# EasyEDA Pro project Archive.eprj, board ALU3.0
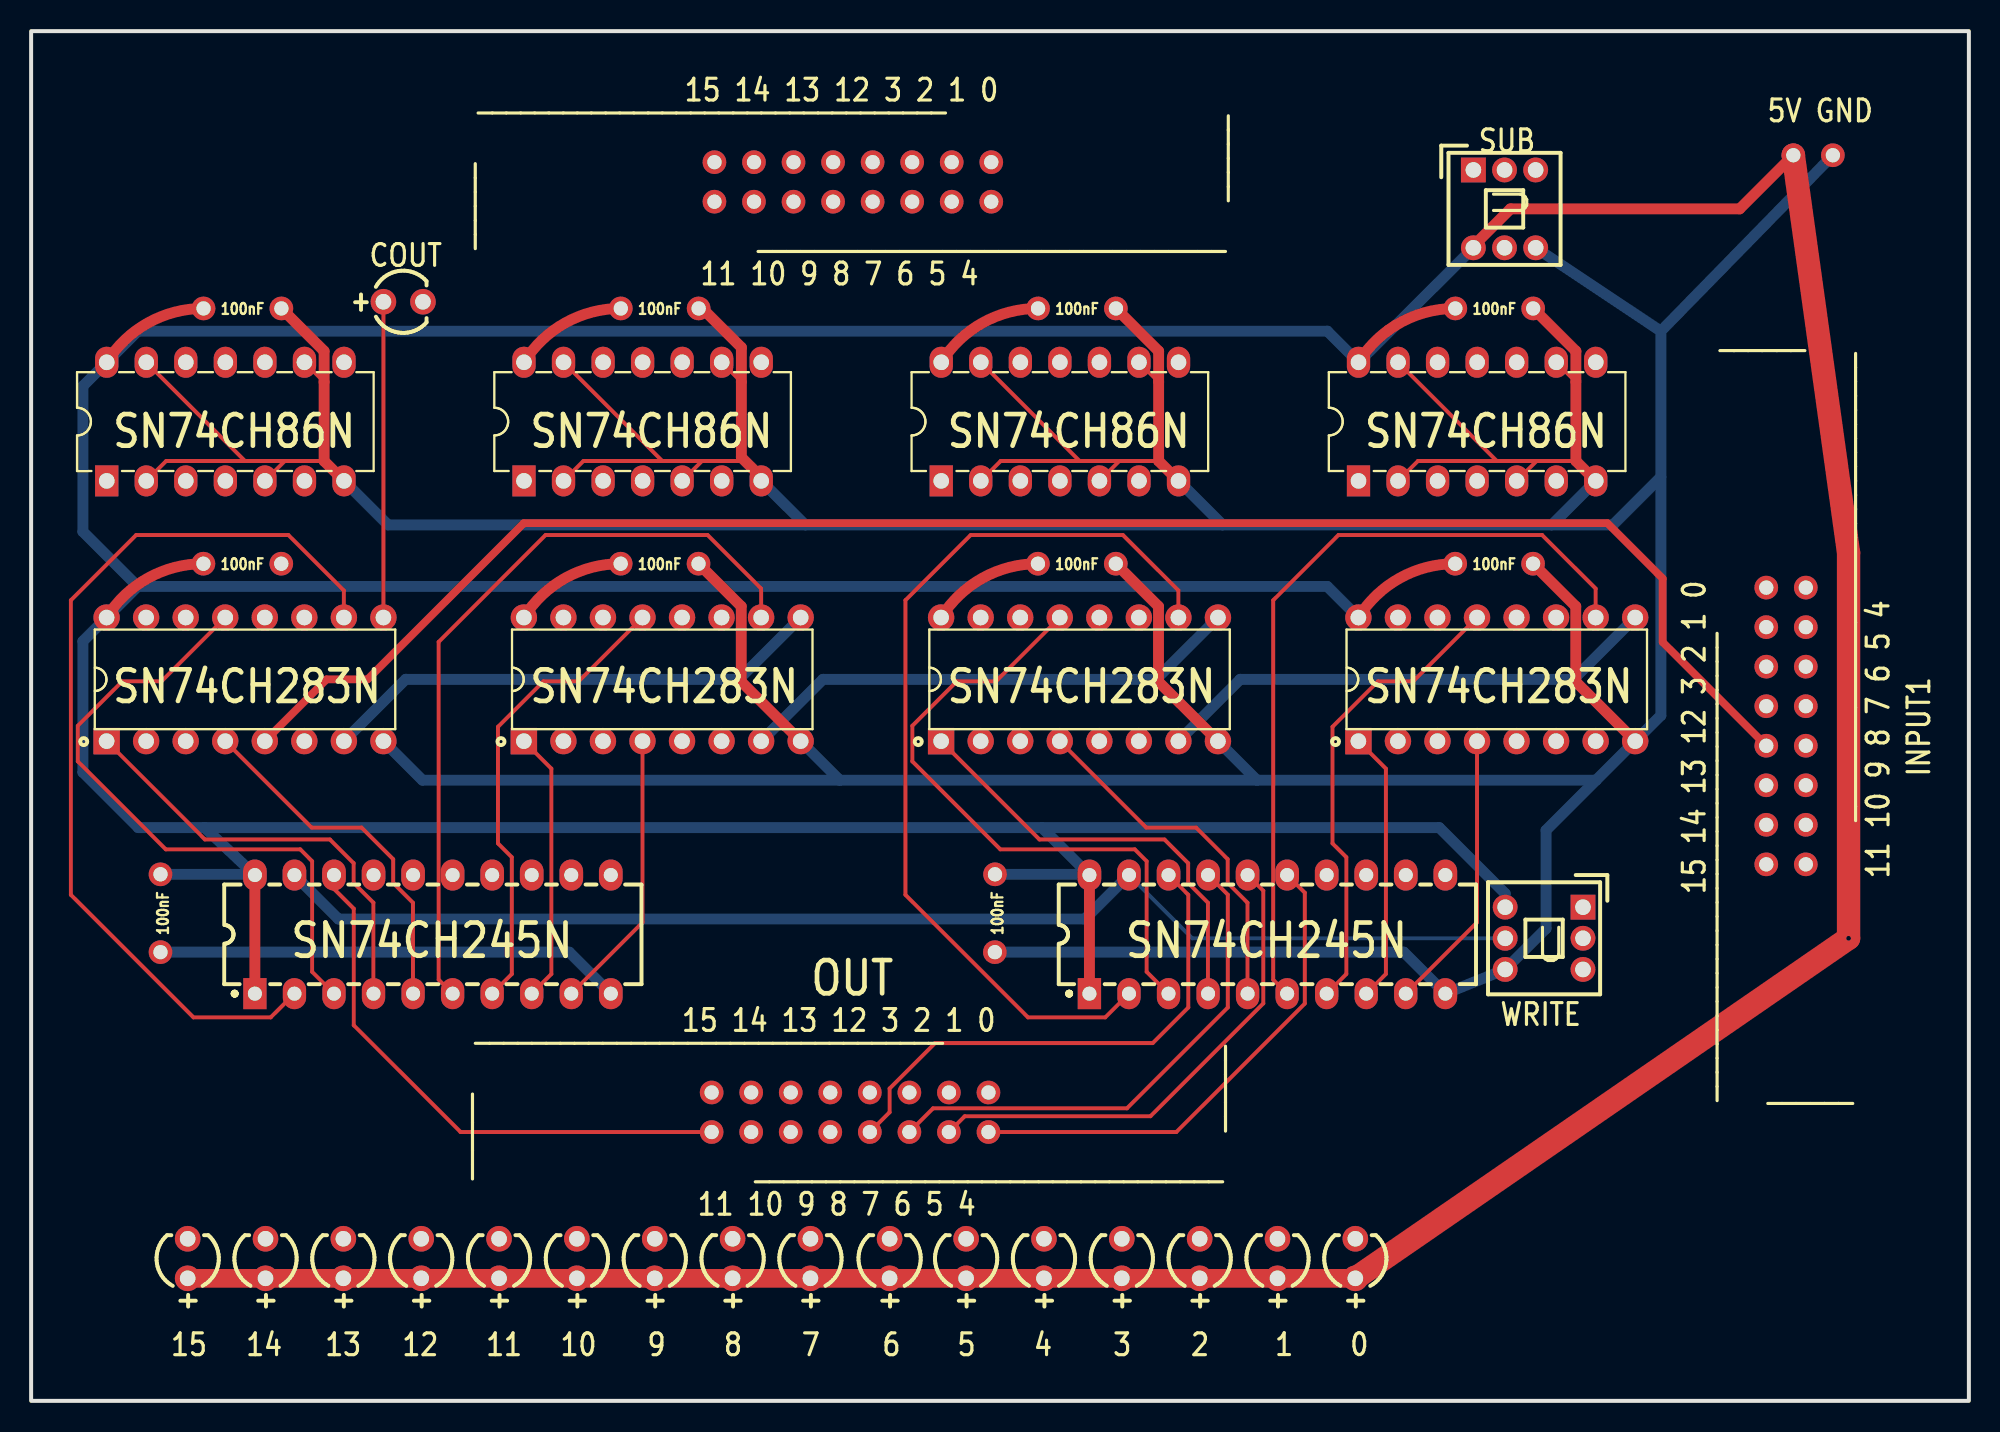
[diagram p12: board, top side]
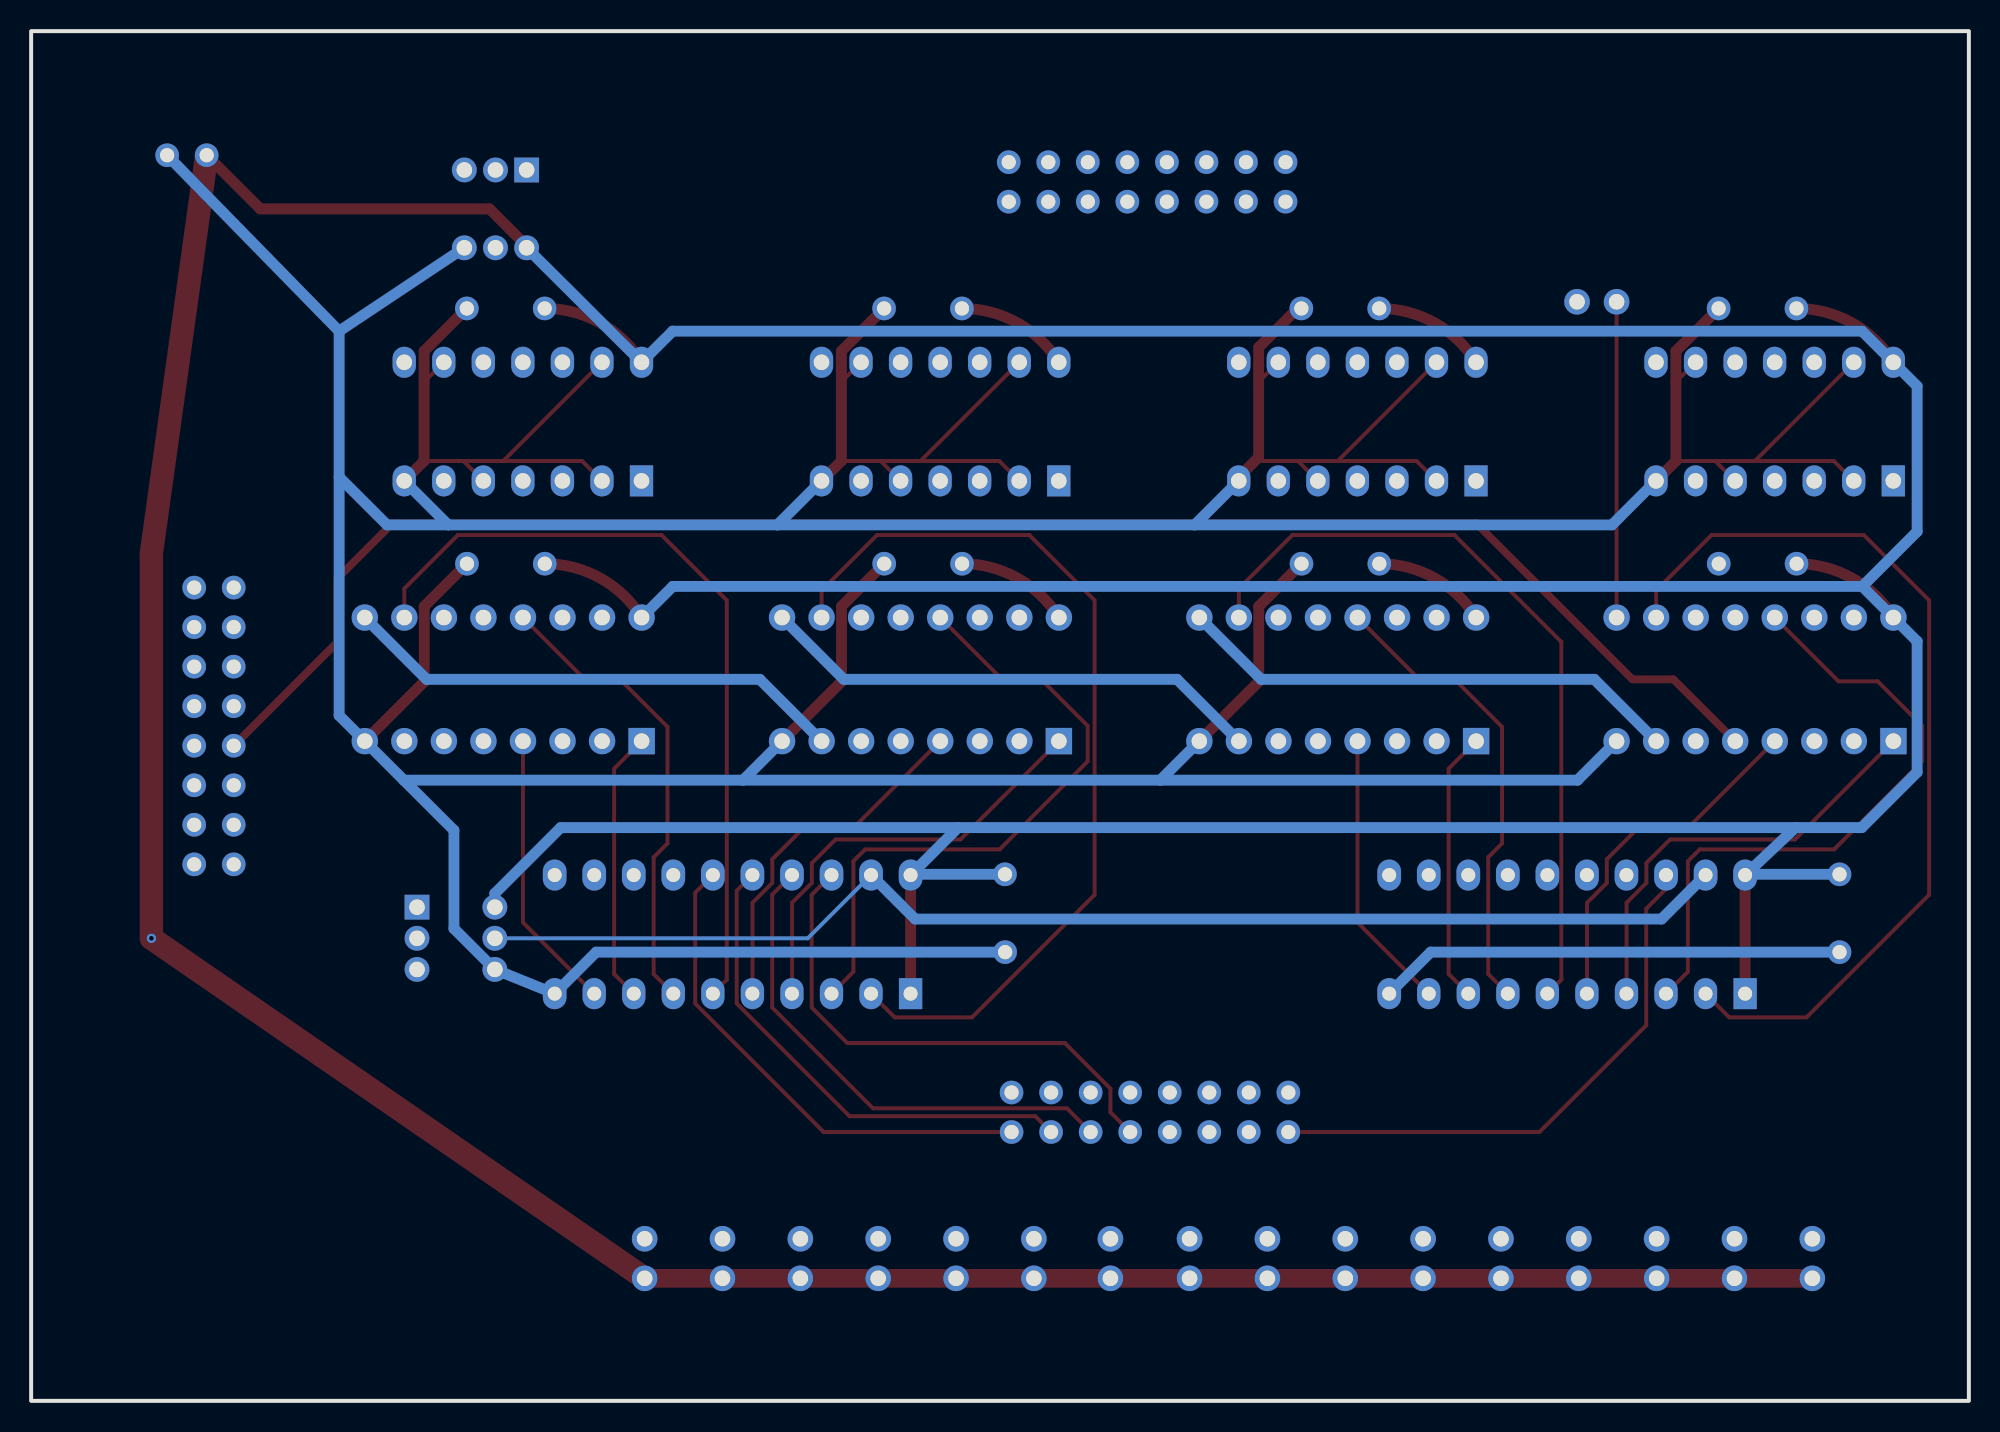
[diagram p13: board, bottom side, seen from below]

Outline 124.46 x 88 mm; copper layers: Top Layer, Inner1, Inner2, Bottom Layer. Coordinates in mm from the lower left corner of the outline.
Outline path: rectangle 0,88 124.46,0
Stack: Top Layer 0.035mm Outer layer thickness 1oz / Dielectric1 0.2104mm 7628 RC49% 8.6mil / Inner1 0.0152mm Inner layer thickness / Dielectric2 1.065mm 1.1mm H/HOZ Copper / Inner2 0.0152mm Inner layer thickness / Dielectric3 0.2104mm 7628 RC49% 8.6mil / Bottom Layer 0.035mm Outer layer thickness 1oz

## Design rules (mm)
template: JLCPCB Capability(Two Layers Board)
spacing copperThickness1oz (default): track to track 0.102, other pairs 0.152 to 0.3
spacing copperThickness2oz: track to track 0.203, other pairs 0.152 to 0.3
track width copperThickness1oz (default): min 0.127, default 0.254, max 2.54
track width copperThickness2oz: min 0.203, default 0.254, max 2.54
differential pair differentialPair (default): width min 0.127, default 0.254, max 2.54; gap min 0.152, default 0.152
via viaSize (default): diameter min 0.5, default 0.61, max 10; hole min 0.3, default 0.305, max 6.3

## Placement (name value [footprint] x y rotation side)
NOREF  -  [Pad_e1800]  43.89 79.58 0 top
NOREF#2  -  [Pad_e1795]  42.87 53.78 90 top
NOREF#3  -  [Pad_e1847]  113.19 80.03 0 top
NOREF#4  -  [Pad_e1811]  51.51 77.04 0 top
NOREF#5  -  [Pad_e1826]  61.49 17.27 0 top
NOREF#6  -  [Pad_e1839]  111.45 47.17 90 top
NOREF#7  -  [Pad_e1837]  96.47 53.78 90 top
NOREF#8  -  [Pad_e1790]  11.07 70.18 90 top
NOREF#9  -  [Pad_e1833]  69.67 53.78 90 top
NOREF#10  -  [Pad_e1852]  113.99 44.63 90 top
NOREF#11  -  [Pad_e1821]  58.95 17.27 0 top
NOREF#12  -  [Pad_e1838]  96.48 70.18 90 top
NOREF#13  -  [Pad_e1853]  113.99 34.47 90 top
NOREF#14  -  [Pad_e1801]  46.25 17.27 0 top
NOREF#15  -  [Pad_e1806]  48.79 19.81 0 top
NOREF#16  -  [Pad_e1842]  111.45 39.55 90 top
NOREF#17  -  [Pad_e1824]  59.13 79.58 0 top
NOREF#18  -  [Pad_e1822]  58.95 19.81 0 top
NOREF#19  -  [Pad_e1808]  48.97 79.58 0 top
NOREF#20  -  [Pad_e1820]  56.59 77.04 0 top
NOREF#21  -  [Pad_e1789]  11.07 53.78 90 top
NOREF#22  -  [Pad_e1791]  16.07 53.78 90 top
NOREF#23  -  [Pad_e1841]  111.45 37.01 90 top
NOREF#24  -  [Pad_e1855]  113.99 39.55 90 top
NOREF#25  -  [Pad_e1799]  43.89 77.04 0 top
NOREF#26  -  [Pad_e1827]  61.67 77.04 0 top
NOREF#27  -  [Pad_e1819]  56.59 79.58 0 top
NOREF#28  -  [Pad_e1804]  46.43 79.58 0 top
NOREF#29  -  [Pad_e1807]  48.97 77.04 0 top
NOREF#30  -  [Pad_e1803]  46.43 77.04 0 top
NOREF#31  -  [Pad_e1792]  16.07 70.18 90 top
NOREF#32  -  [Pad_e1843]  111.45 52.25 90 top
NOREF#33  -  [Pad_e1828]  61.67 79.58 0 top
NOREF#34  -  [Pad_e1848]  113.99 52.25 90 top
NOREF#35  -  [Pad_e1818]  56.41 19.81 0 top
NOREF#36  -  [Pad_e1816]  54.05 79.58 0 top
NOREF#37  -  [Pad_e1812]  51.51 79.58 0 top
NOREF#38  -  [Pad_e1849]  113.99 49.71 90 top
NOREF#39  -  [Pad_e1845]  111.45 42.09 90 top
NOREF#40  -  [Pad_e1854]  113.99 37.01 90 top
NOREF#41  -  [Pad_e1797]  43.71 17.27 0 top
NOREF#42  -  [Pad_e1815]  54.05 77.04 0 top
NOREF#43  -  [Pad_e1834]  69.68 70.18 90 top
NOREF#44  -  [Pad_e1850]  113.99 47.17 90 top
NOREF#45  -  [Pad_e1813]  53.87 19.81 0 top
NOREF#46  -  [Pad_e1831]  64.67 53.78 90 top
NOREF#47  -  [Pad_e1840]  111.45 34.47 90 top
NOREF#48  -  [Pad_e1823]  59.13 77.04 0 top
NOREF#49  -  [Pad_e1805]  48.79 17.27 0 top
NOREF#50  -  [Pad_e1846]  111.45 44.63 90 top
NOREF#51  -  [Pad_e1835]  91.47 53.78 90 top
NOREF#52  -  [Pad_e1810]  51.33 19.81 0 top
NOREF#53  -  [Pad_e1832]  64.68 70.18 90 top
NOREF#54  -  [Pad_e1809]  51.33 17.27 0 top
NOREF#55  -  [Pad_e1825]  61.49 19.81 0 top
NOREF#56  -  [Pad_e1802]  46.25 19.81 0 top
NOREF#57  -  [Pad_e1798]  43.71 19.81 0 top
NOREF#58  -  [Pad_e1829]  61.9 28.83 0 top
NOREF#59  -  [Pad_e1793]  37.87 53.78 90 top
NOREF#60  -  [Pad_e1851]  113.99 42.09 90 top
NOREF#61  -  [Pad_e1856]  115.73 80.03 0 top
NOREF#62  -  [Pad_e1788]  8.31 28.83 180 top
NOREF#63  -  [Pad_e1844]  111.45 49.71 90 top
NOREF#64  -  [Pad_e1836]  91.48 70.18 90 top
NOREF#65  -  [Pad_e1814]  53.87 17.27 0 top
NOREF#66  -  [Pad_e1830]  61.91 33.83 180 top
NOREF#67  -  [Pad_e1794]  37.87 70.18 90 top
NOREF#68  -  [Pad_e1787]  8.31 33.83 180 top
NOREF#69  -  [Pad_e1817]  56.41 17.27 0 top
NOREF#70  -  [Pad_e1796]  42.87 70.18 90 top
SW2  -  [SW-TH_6P-L7.0-W7.0-P2.00]  94.64 76.58 90 top
SW2#2  -  [SW-TH_6P-L7.0-W7.0-P2.00]  97.18 29.72 0 top
U5  SN74HC245N  [DIP-20_L26.8-W6.4-P2.54-LS7.6-BL]  25.8 29.97 0 top
U6  -  [LED-TH_BD4.0-P2.54-FD_RED]  23.9 70.61 0 top
U6#2  -  [DIP-20_L26.8-W6.4-P2.54-LS7.6-BL]  79.4 29.97 0 top
U7  -  [DIP-16_L19.3-W6.4-P2.54-LS7.94-BL]  13.74 46.36 0 top
U7#2  -  [DIP-16_L19.3-W6.4-P2.54-LS7.94-BL]  40.54 46.36 0 top
U7#3  -  [DIP-16_L19.3-W6.4-P2.54-LS7.94-BL]  67.34 46.36 0 top
U7#4  -  [DIP-16_L19.3-W6.4-P2.54-LS7.94-BL]  94.14 46.36 0 top
U8  -  [DIP-14_L19.0-W6.4-P2.54-LS7.6-BL]  12.47 62.92 0 top
U8#2  -  [DIP-14_L19.0-W6.4-P2.54-LS7.6-BL]  39.28 62.92 0 top
U8#3  -  [DIP-14_L19.0-W6.4-P2.54-LS7.6-BL]  66.08 62.92 0 top
U8#4  -  [DIP-14_L19.0-W6.4-P2.54-LS7.6-BL]  92.88 62.92 0 top
U14  -  [LED-TH_BD4.0-P2.54-FD_RED]  10.05 9.14 90 top
U14#2  -  [LED-TH_BD4.0-P2.54-FD_RED]  15.05 9.14 90 top
U14#3  -  [LED-TH_BD4.0-P2.54-FD_RED]  20.05 9.14 90 top
U14#4  -  [LED-TH_BD4.0-P2.54-FD_RED]  25.05 9.14 90 top
U14#5  -  [LED-TH_BD4.0-P2.54-FD_RED]  30.05 9.14 90 top
U14#6  -  [LED-TH_BD4.0-P2.54-FD_RED]  35.05 9.14 90 top
U14#7  -  [LED-TH_BD4.0-P2.54-FD_RED]  40.05 9.14 90 top
U14#8  -  [LED-TH_BD4.0-P2.54-FD_RED]  45.05 9.14 90 top
U14#9  -  [LED-TH_BD4.0-P2.54-FD_RED]  50.05 9.14 90 top
U14#10  -  [LED-TH_BD4.0-P2.54-FD_RED]  55.14 9.14 90 top
U14#11  -  [LED-TH_BD4.0-P2.54-FD_RED]  60.05 9.14 90 top
U14#12  -  [LED-TH_BD4.0-P2.54-FD_RED]  65.05 9.14 90 top
U14#13  -  [LED-TH_BD4.0-P2.54-FD_RED]  70.05 9.14 90 top
U14#14  -  [LED-TH_BD4.0-P2.54-FD_RED]  75.05 9.14 90 top
U14#15  -  [LED-TH_BD4.0-P2.54-FD_RED]  80.05 9.14 90 top
U14#16  -  [LED-TH_BD4.0-P2.54-FD_RED]  85.05 9.14 90 top

## Footprints (pads in the part's own frame, mm; a bottom-side part is the same pattern mirrored in y, then rotated)
DIP-14_L19.0-W6.4-P2.54-LS7.6-BL
  rect 1.5x2 hole 1: 1(-7.62,-3.81)
  oval 1.5x2 hole 1: 2(-5.08,-3.81) 3(-2.54,-3.81) 4(0,-3.81) 5(2.54,-3.81) 6(5.08,-3.81) 7(7.62,-3.81) 8(7.62,3.81) 9(5.08,3.81) 10(2.54,3.81) 11(0,3.81) 12(-2.54,3.81) 13(-5.08,3.81) 14(-7.62,3.81)
DIP-16_L19.3-W6.4-P2.54-LS7.94-BL
  rect 1.7x1.7 hole 1: 1(-8.89,-3.97)
  round 1.7 hole 1: 2(-6.35,-3.97) 3(-3.81,-3.97) 4(-1.27,-3.97) 5(1.27,-3.97) 6(3.81,-3.97) 7(6.35,-3.97) 8(8.89,-3.97) 9(8.89,3.97) 10(6.35,3.97) 11(3.81,3.97) 12(1.27,3.97) 13(-1.27,3.97) 14(-3.81,3.97) 15(-6.35,3.97) 16(-8.89,3.97)
DIP-20_L26.8-W6.4-P2.54-LS7.6-BL
  rect 1.5x2 hole 0.9: 1(-11.43,-3.81)
  oval 1.5x2 hole 0.9: 2(-8.89,-3.81) 3(-6.35,-3.81) 4(-3.81,-3.81) 5(-1.27,-3.81) 6(1.27,-3.81) 7(3.81,-3.81) 8(6.35,-3.81) 9(8.89,-3.81)
  oval 1.524x2 hole 0.9: 10(11.43,-3.81) 11(11.43,3.81) 12(8.89,3.81) 13(6.35,3.81) 14(3.81,3.81) 15(1.27,3.81) 16(-1.27,3.81) 17(-3.81,3.81) 18(-6.35,3.81) 19(-8.89,3.81) 20(-11.43,3.81)
LED-TH_BD4.0-P2.54-FD_RED
  round 1.651 hole 1: 1(-1.27,0) 2(1.27,0)
Pad_e1787
  round 1.524 hole 0.914: 2(0,0)
Pad_e1788
  round 1.524 hole 0.914: 1(0,0)
Pad_e1789
  round 1.524 hole 0.914: 2(0,0)
Pad_e1790
  round 1.524 hole 0.914: 2(0,0)
Pad_e1791
  round 1.524 hole 0.914: 1(0,0)
Pad_e1792
  round 1.524 hole 0.914: 1(0,0)
Pad_e1793
  round 1.524 hole 0.914: 2(0,0)
Pad_e1794
  round 1.524 hole 0.914: 2(0,0)
Pad_e1795
  round 1.524 hole 0.914: 1(0,0)
Pad_e1796
  round 1.524 hole 0.914: 1(0,0)
Pad_e1797
  round 1.524 hole 0.914: 11(0,0)
Pad_e1798
  round 1.524 hole 0.914: 15(0,0)
Pad_e1799
  round 1.524 hole 0.914: 11(0,0)
Pad_e1800
  round 1.524 hole 0.914: 15(0,0)
Pad_e1801
  round 1.524 hole 0.914: 10(0,0)
Pad_e1802
  round 1.524 hole 0.914: 14(0,0)
Pad_e1803
  round 1.524 hole 0.914: 10(0,0)
Pad_e1804
  round 1.524 hole 0.914: 14(0,0)
Pad_e1805
  round 1.524 hole 0.914: 9(0,0)
Pad_e1806
  round 1.524 hole 0.914: 13(0,0)
Pad_e1807
  round 1.524 hole 0.914: 9(0,0)
Pad_e1808
  round 1.524 hole 0.914: 13(0,0)
Pad_e1809
  round 1.524 hole 0.914: 8(0,0)
Pad_e1810
  round 1.524 hole 0.914: 12(0,0)
Pad_e1811
  round 1.524 hole 0.914: 8(0,0)
Pad_e1812
  round 1.524 hole 0.914: 12(0,0)
Pad_e1813
  round 1.524 hole 0.914: 3(0,0)
Pad_e1814
  round 1.524 hole 0.914: 7(0,0)
Pad_e1815
  round 1.524 hole 0.914: 7(0,0)
Pad_e1816
  round 1.524 hole 0.914: 3(0,0)
Pad_e1817
  round 1.524 hole 0.914: 6(0,0)
Pad_e1818
  round 1.524 hole 0.914: 2(0,0)
Pad_e1819
  round 1.524 hole 0.914: 2(0,0)
Pad_e1820
  round 1.524 hole 0.914: 6(0,0)
Pad_e1821
  round 1.524 hole 0.914: 5(0,0)
Pad_e1822
  round 1.524 hole 0.914: 1(0,0)
Pad_e1823
  round 1.524 hole 0.914: 5(0,0)
Pad_e1824
  round 1.524 hole 0.914: 1(0,0)
Pad_e1825
  round 1.524 hole 0.914: 0(0,0)
Pad_e1826
  round 1.524 hole 0.914: 4(0,0)
Pad_e1827
  round 1.524 hole 0.914: 4(0,0)
Pad_e1828
  round 1.524 hole 0.914: 0(0,0)
Pad_e1829
  round 1.524 hole 0.914: 1(0,0)
Pad_e1830
  round 1.524 hole 0.914: 2(0,0)
Pad_e1831
  round 1.524 hole 0.914: 2(0,0)
Pad_e1832
  round 1.524 hole 0.914: 2(0,0)
Pad_e1833
  round 1.524 hole 0.914: 1(0,0)
Pad_e1834
  round 1.524 hole 0.914: 1(0,0)
Pad_e1835
  round 1.524 hole 0.914: 2(0,0)
Pad_e1836
  round 1.524 hole 0.914: 2(0,0)
Pad_e1837
  round 1.524 hole 0.914: 1(0,0)
Pad_e1838
  round 1.524 hole 0.914: 1(0,0)
Pad_e1839
  round 1.524 hole 0.914: 2(0,0)
Pad_e1840
  round 1.524 hole 0.914: 15(0,0)
Pad_e1841
  round 1.524 hole 0.914: 14(0,0)
Pad_e1842
  round 1.524 hole 0.914: 13(0,0)
Pad_e1843
  round 1.524 hole 0.914: 0(0,0)
Pad_e1844
  round 1.524 hole 0.914: 1(0,0)
Pad_e1845
  round 1.524 hole 0.914: 12(0,0)
Pad_e1846
  round 1.524 hole 0.914: 3(0,0)
Pad_e1847
  round 1.524 hole 0.914: 1(0,0)
Pad_e1848
  round 1.524 hole 0.914: 4(0,0)
Pad_e1849
  round 1.524 hole 0.914: 5(0,0)
Pad_e1850
  round 1.524 hole 0.914: 6(0,0)
Pad_e1851
  round 1.524 hole 0.914: 8(0,0)
Pad_e1852
  round 1.524 hole 0.914: 7(0,0)
Pad_e1853
  round 1.524 hole 0.914: 11(0,0)
Pad_e1854
  round 1.524 hole 0.914: 10(0,0)
Pad_e1855
  round 1.524 hole 0.914: 9(0,0)
Pad_e1856
  round 1.524 hole 0.914: 2(0,0)
SW-TH_6P-L7.0-W7.0-P2.00
  rect 1.6x1.6 hole 1: 1(2.499,2)
  round 1.6 hole 1: 2(2.5,0) 3(2.5,-2) 4(-2.5,2) 5(-2.5,0) 6(-2.5,-2)

## Nets

Pads without a net: NOREF 15; NOREF#2 1; NOREF#3 1; NOREF#4 8; NOREF#5 4; NOREF#6 2; NOREF#7 1; NOREF#8 2; NOREF#9 1; NOREF#10 7; NOREF#11 5; NOREF#12 1; NOREF#13 11; NOREF#14 10; NOREF#15 13; NOREF#16 13; NOREF#17 1; NOREF#18 1; NOREF#19 13; NOREF#20 6; NOREF#21 2; NOREF#22 1; NOREF#23 14; NOREF#24 9; NOREF#25 11; NOREF#26 4; NOREF#27 2; NOREF#28 14; NOREF#29 9; NOREF#30 10; NOREF#31 1; NOREF#32 0; NOREF#33 0; NOREF#34 4; NOREF#35 2; NOREF#36 3; NOREF#37 12; NOREF#38 5; NOREF#39 12; NOREF#40 10; NOREF#41 11; NOREF#42 7; NOREF#43 1; NOREF#44 6; NOREF#45 3; NOREF#46 2; NOREF#47 15; NOREF#48 5; NOREF#49 9; NOREF#50 3; NOREF#51 2; NOREF#52 12; NOREF#53 2; NOREF#54 8; NOREF#55 0; NOREF#56 14; NOREF#57 15; NOREF#58 1; NOREF#59 2; NOREF#60 8; NOREF#61 2; NOREF#62 1; NOREF#63 1; NOREF#64 2; NOREF#65 7; NOREF#66 2; NOREF#67 2; NOREF#68 2; NOREF#69 6; NOREF#70 1; SW2 1 2 3 4 5 6; SW2#2 1 2 3 4 5 6; U5 1 2 3 4 5 6 7 8 9 10 11 12 13 14 15 16 17 18 19 20; U6 1 2; U6#2 1 2 3 4 5 6 7 8 9 10 11 12 13 14 15 16 17 18 19 20; U7 1 2 3 4 5 6 7 8 9 10 11 12 13 14 15 16; U7#2 1 2 3 4 5 6 7 8 9 10 11 12 13 14 15 16; U7#3 1 2 3 4 5 6 7 8 9 10 11 12 13 14 15 16; U7#4 1 2 3 4 5 6 7 8 9 10 11 12 13 14 15 16; U8 1 2 3 4 5 6 7 8 9 10 11 12 13 14; U8#2 1 2 3 4 5 6 7 8 9 10 11 12 13 14; U8#3 1 2 3 4 5 6 7 8 9 10 11 12 13 14; U8#4 1 2 3 4 5 6 7 8 9 10 11 12 13 14; U14 1 2; U14#2 1 2; U14#3 1 2; U14#4 1 2; U14#5 1 2; U14#6 1 2; U14#7 1 2; U14#8 1 2; U14#9 1 2; U14#10 1 2; U14#11 1 2; U14#12 1 2; U14#13 1 2; U14#14 1 2; U14#15 1 2; U14#16 1 2

## Via types
v1: diameter 0.61, hole 0.305, Top Layer to Bottom Layer, 1 via

## Routing (per net, layer and track width the routed paths; a pad name or vN(x,y) marks a point on that pad's centre or on a via; arc(x,y) is an arc through that point)
(no net): length 4982.9
  Top Layer w0.254: U8#2.5 43.09,60.38 ; 43.09,60.38 40.54,60.38 ; 43.09,60.38 45.62,60.38 ; 94.14,60.38 96.69,60.38 ; 94.14,60.38 87.8,66.72 ; 94.14,60.38 89.07,60.38 U8#4.2 ; 96.69,60.38 U8#4.5 ; 96.69,60.38 99.22,60.38 ; 97.96,66.72 99.22,65.46 ; U8#3.2 62.27,60.38 67.34,60.38 ; 40.54,60.38 35.47,60.38 U8#2.2 ; 40.54,60.38 34.19,66.72 ; U6.1 U7.9 ; U6#2.9 92.87,30.74 U7#4.4 ; U7#2.13 35.17,46.23 32.91,46.23 29.98,43.31 29.98,35.81 30.87,34.92 30.87,27.42 U5.7 ; U6#2.15 81.81,32.65 81.81,25.53 73.55,17.27 NOREF#5.4 ; U6#2.6 79.78,27.06 79.78,51.44 83.97,55.63 97.05,55.63 100.49,52.19 U7#4.10 ; NOREF#65.7 55.14,18.54 55.14,20.07 58.06,22.99 72.04,22.99 74.32,25.27 74.32,32.51 73.06,33.77 73.06,33.78 ; U5.8 33.41,27.42 33.41,40.62 U7#2.1 ; U5.2 15.39,24.64 10.43,24.64 2.55,32.51 2.55,51.44 6.74,55.63 16.52,55.63 20.09,52.06 20.09,50.33 ; U7#2.4 39.27,30.74 U5.9 ; U5.5 24.52,26.17 24.52,32 23.25,33.27 23.25,34.8 21.22,36.83 18.02,36.83 U7.4 ; U8#3.5 69.89,60.38 ; 69.89,60.38 67.34,60.38 ; 69.89,60.38 72.42,60.38 ; 13.74,60.38 8.67,60.38 U8.2 ; 13.74,60.38 16.29,60.38 ; 13.74,60.38 7.39,66.72 ; U7#4.13 88.77,46.23 86.51,46.23 83.59,43.31 83.59,35.81 84.48,34.92 84.48,27.42 U6#2.7 ; 75.6,33.78 76.86,32.52 76.86,25.27 70.39,18.8 57.93,18.8 NOREF#69.6 ; U6#2.2 68.99,24.64 64.03,24.64 56.16,32.51 56.16,51.44 60.35,55.63 70.12,55.63 73.69,52.06 U7#3.10 ; U7#3.1 64.77,36.07 72.79,36.07 74.32,34.54 74.32,33.27 75.59,32 75.59,26.17 U6#2.4 ; U5.14 29.74,33.91 29.87,33.78 ; 16.29,60.38 18.82,60.38 ; 16.29,60.38 U8.5 ; 67.34,60.38 61,66.72 ; 17.55,66.72 18.82,65.46 ; U7#3.4 71.62,36.83 74.82,36.83 76.86,34.8 76.86,33.27 78.13,32 78.13,26.17 U6#2.5 ; U5.3 18.05,27.57 18.05,34.67 17.28,35.43 8.65,35.43 3,41.08 3,43.37 5.86,46.23 8.37,46.23 U7.13 ; U5.6 26.17,27.06 26.17,48.76 33.04,55.63 43.45,55.63 46.89,52.19 U7#2.10 ; U7.1 11.16,36.07 19.19,36.07 20.71,34.54 20.71,33.27 21.98,32 21.98,26.17 U5.4 ; 78.14,33.78 78.14,33.77 79.14,32.77 79.14,25.53 71.9,18.29 59.97,18.29 NOREF#11.5 ; U7#3.13 61.97,46.23 59.46,46.23 56.6,43.37 56.6,41.08 62.25,35.43 70.89,35.43 71.65,34.67 71.65,27.57 U6#2.3 ; 71.16,66.72 72.42,65.46 ; 44.35,66.72 45.62,65.46 ; U6#2.8 87.02,27.42 87.02,40.62 85.25,42.39 ; U5.18 19.45,32.89 20.72,31.62 20.72,24.13 27.58,17.27 NOREF#41.11
  Top Layer w0.5: 15.01,42.39 18.98,46.36 21.61,46.36 31.64,56.39 101.24,56.39 104.8,52.83 104.8,48.74 NOREF#39.12
  Top Layer w0.7: NOREF#12.1 99.22,67.44 99.22,60.38 U8#4.7 ; U5.20 U5.1 ; NOREF#9.1 72.41,51.04 72.41,46.2 U7#3.8 ; SW2.4 92.64,74.2 95.02,76.58 109.74,76.58 NOREF#3.1 ; 42.87,70.42 45.62,67.68 45.62,60.62 46.9,59.34 ; U6#2.20 U6#2.1 ; U8#3.7 72.42,60.38 72.42,67.44 NOREF#43.1 ; U7#4.8 99.21,46.2 99.21,51.04 NOREF#7.1 ; U7#2.8 45.61,46.2 45.61,51.04 NOREF#2.1 ; U8.7 18.82,60.38 18.82,67.44 NOREF#31.1 ; NOREF#51.2 arc(87.91,52.86) 85.25,50.33 ; NOREF#46.2 arc(61.11,52.86) U7#3.16 ; NOREF#64.2 arc(89.47,69.9) 87.62,69.09 arc(87.4,68.94) 87.18,68.79 arc(86.12,67.85) 85.26,66.72 ; NOREF#21.2 arc(7.51,52.86) U7.16 ; NOREF#53.2 arc(61.12,69.26) 58.46,66.72 ; NOREF#59.2 arc(34.31,52.86) U7#2.16 ; NOREF#67.2 arc(34.32,69.26) 31.66,66.72 ; NOREF#8.2 arc(7.52,69.26) 4.85,66.72
  Top Layer w1.2: U14#16.1 U14#15.1 U14#14.1 U14#13.1 U14#12.1 U14#11.1 U14#10.1 U14#9.1 U14#8.1 U14#7.1 U14#6.1 U14#5.1 U14#4.1 U14#3.1 U14#2.1 U14.1
  Top Layer w1.5: U14#16.1 v1(116.73,29.72) 116.73,54.48 NOREF#3.1
  Inner1 w0.254: 92.88,66.72 94.22,68.07 101.11,68.07 102,67.18 102,54.38 U7#4.11 ; 87.79,42.39 94.13,48.72 94.13,55.28 U8#4.6 ; U7#3.6 69.87,43.67 69.87,51.31 72.41,53.85 72.41,59.56 71.01,60.96 65.39,60.96 U8#3.3 ; U5.18 19.45,28.84 20.6,27.69 20.6,20.96 U14.2 ; NOREF#16.13 109.77,39.55 109.34,39.12 13.2,39.12 9.93,42.39 ; NOREF.15 22.79,79.58 9.93,66.72 ; U5.15 27.07,28.84 28.22,27.69 28.22,13.63 25.01,10.41 ; 87.79,50.33 89.18,51.71 89.18,60.45 91.21,62.48 96.26,62.48 100.5,66.72 ; NOREF#36.3 55.24,80.77 76.29,80.77 90.34,66.72 ; U7#4.7 101.75,43.64 101.75,51.31 102.89,52.45 102.89,68.07 101.49,69.47 99.25,69.47 SW2.5 ; U7.6 16.27,43.67 16.27,51.31 18.81,53.85 18.81,59.56 17.41,60.96 11.79,60.96 U8.3 ; U7#2.11 48.4,54.38 48.4,67.18 47.51,68.07 40.62,68.07 39.28,66.72 ; U7.15 8.77,51.71 8.77,60.45 10.81,62.48 15.85,62.48 20.09,66.72 ; U5.14 29.61,28.84 30.76,27.69 30.76,11.17 30.01,10.41 ; 12.47,66.72 13.82,68.07 20.71,68.07 21.6,67.18 21.6,54.38 U7.11 ; 85.01,10.41 89.68,15.09 89.68,27.69 90.83,28.84 U6#2.11 ; U7#2.15 35.57,51.71 35.57,60.45 37.61,62.48 42.65,62.48 46.9,66.72 ; U6#2.13 85.75,28.84 84.6,27.69 84.6,20.01 75.01,10.41 ; U5.13 32.15,28.84 33.3,27.69 33.3,12.12 35.01,10.41 ; U5.16 24.53,28.84 25.68,27.69 25.68,16.09 20.01,10.41 ; U6#2.14 83.21,28.84 82.06,27.69 82.06,22.47 70.01,10.41 ; U6#2.16 78.13,28.84 76.98,27.69 76.98,24.89 62.5,10.41 60.09,10.41 ; U7#2.6 43.07,43.67 43.07,51.31 45.61,53.85 45.61,59.56 44.21,60.96 38.59,60.96 U8#2.3 ; 45.01,10.41 38.38,17.04 38.38,27.69 37.23,28.84 U5.11 ; U8#4.3 92.19,60.96 97.81,60.96 99.21,59.56 99.21,53.85 96.67,51.31 96.67,43.67 U7#4.6 ; U6#2.18 73.05,28.84 71.9,27.69 71.9,24.89 59.71,12.7 52.29,12.7 50.01,10.41 ; U7#3.11 75.2,54.38 75.2,67.18 74.31,68.07 67.42,68.07 66.08,66.72 ; 71.16,66.72 68.57,64.14 58.44,64.14 56.59,65.99 NOREF#20.6 ; U8#3.6 67.33,55.28 67.33,48.72 U7#3.2 ; 40.01,10.41 35.84,14.58 35.84,27.69 34.69,28.84 U5.12 ; NOREF#10.7 112.79,43.43 110.89,43.43 108.48,41.02 69.97,41.02 U7#3.5 ; U7#3.15 62.37,51.71 62.37,60.45 64.41,62.48 69.46,62.48 73.7,66.72 ; U7.2 13.73,48.72 13.73,55.28 U8.6 ; 65.01,10.41 79.52,24.93 79.52,27.69 80.67,28.84 U6#2.15 ; 55.01,10.41 56.4,11.81 61.36,11.81 74.44,24.89 74.44,27.69 75.59,28.84 U6#2.17 ; U7#2.3 38.47,40.64 112.9,40.64 NOREF#24.9 ; NOREF#42.7 55.24,78.23 62.38,78.23 63.54,77.07 63.54,66.72 ; U5.17 21.99,28.84 23.14,27.69 23.14,18.5 U14#2.2 ; U6#2.12 88.29,28.84 87.14,27.69 87.14,17.55 80.01,10.41 ; U8#2.6 40.53,55.28 40.53,48.72 U7#2.2
  Inner1 w0.7: U7.8 25.17,44.92 U6.2
  Inner2 w0.254: NOREF#4.8 51.51,61.65 47.65,57.78 32.97,57.78 U8#2.1 ; NOREF#38.5 113.99,48.56 112.92,47.5 112.92,43.94 112.16,43.18 108.35,43.18 104.41,39.24 65.04,39.24 62.25,42.04 62.25,43.96 U7#3.12 ; NOREF#25.11 43.89,73.88 36.73,66.72 ; NOREF#57.15 41.55,19.81 35.96,25.4 35.96,27.43 U5.14 ; U7#4.3 91.95,40.77 103.15,40.77 111.45,49.07 NOREF#63.1 ; NOREF#40.10 115.59,38.61 115.59,53.47 113.56,55.5 48.65,55.5 45.48,52.32 38.73,52.32 U7#2.14 ; U6#2.12 87.14,32.63 87.14,25.53 82.95,21.34 60.47,21.34 NOREF#18.1 ; NOREF#50.3 107.9,44.63 103.53,40.26 90.44,40.26 89.05,41.66 89.05,43.96 95.41,50.33 ; 95.41,42.39 97.6,44.58 103.78,44.58 NOREF#32.0 ; U7#2.12 37.99,46.51 37.99,41.02 40.79,38.23 112.03,38.23 112.8,37.47 112.8,35.66 NOREF#13.11 ; NOREF#29.9 48.97,63.43 46.5,60.96 41.13,60.96 U8#2.4 ; U8#4.4 91.43,57.66 84.48,57.66 82.7,59.44 82.7,76.96 80.79,78.87 63.27,78.87 62.5,78.11 58.06,78.11 NOREF#27.2 ; U6#2.13 84.48,32.5 84.48,25.53 80.92,21.97 58.57,21.97 NOREF#35.2 ; NOREF#56.14 32.28,33.78 U5.13 ; NOREF#33.0 61.97,79.88 84.8,79.88 97.96,66.72 ; NOREF#44.6 115.21,48.39 115.21,53.34 113.56,54.99 74.95,54.99 72.28,52.32 65.53,52.32 U7#3.14 ; U5.17 23.26,32.51 23.26,25.27 32.66,15.88 49.93,15.88 NOREF#54.8 49.81,18.8 34.82,18.8 28.34,25.27 28.34,32.51 U5.15 ; U8.4 14.33,60.96 21.86,60.96 39.39,78.49 48.53,78.49 48.97,78.92 NOREF#19.13 ; U5.16 25.8,32.51 25.8,25.27 32.66,18.41 47.65,18.41 NOREF#49.9 ; NOREF#37.12 50.03,78.11 41.04,78.11 20.72,57.78 6.17,57.78 U8.1 ; 15.01,50.33 12.75,52.58 10.44,52.58 8.66,50.8 8.66,41.28 13.86,36.07 109.85,36.07 NOREF#47.15 ; U5.11 37.36,33.78 NOREF#52.12 ; U7#3.3 66.16,39.75 104.03,39.75 107.84,43.56 112.03,43.56 112.54,44.07 112.54,47.62 112.92,48.01 112.92,51.19 NOREF#34.4 ; NOREF#55.0 83.84,19.81 89.56,25.53 89.56,32.5 U6#2.11 ; 9.93,50.33 11.2,49.06 11.2,41.66 15.84,37.01 NOREF#23.14 ; U7#4.14 92.33,52.32 99.08,52.32 100.48,53.72 111.78,53.72 112.54,52.96 112.54,48.27 NOREF#6.2 ; U6#2.14 81.94,32.5 81.94,25.53 79.01,22.61 56.66,22.61 NOREF#45.3 ; U8#4.1 83.97,60.39 83.97,77.6 82.19,79.38 63.27,79.38 62.38,78.49 60.22,78.49 NOREF#17.1 ; NOREF#60.8 112.54,40.64 110.13,40.64 108.22,38.73 45.46,38.73 U7#2.5 ; NOREF#26.4 62.12,76.59 62.12,62.77 U8#3.1 ; NOREF#48.5 56.41,74.32 56.41,58.8 57.43,57.78 64.76,57.78 U8#3.4 ; U5.12 48.66,19.81 NOREF#15.13 ; 44.35,66.72 46.43,68.8 NOREF#30.10 ; 17.55,66.72 17.55,68.97 29.87,81.28 44.73,81.28 NOREF#28.14
  Inner2 w0.7: NOREF#22.1 18.82,51.03 18.82,46.19 U7.8
  Bottom Layer w0.254: U6#2.19 74.58,29.72 SW2#2.5
  Bottom Layer w0.7: 6.85,52.32 83.25,52.32 85.25,50.33 ; 6.85,52.32 U7.16 3.32,48.8 3.32,40.39 6.88,36.83 11.14,36.83 ; 6.85,52.32 3.32,55.85 3.32,65.19 6.85,68.72 83.26,68.72 85.26,66.72 SW2.4 ; SW2#2.4 94.68,32.6 90.44,36.83 64.93,36.83 ; NOREF#62.1 34.56,28.83 U5.10 ; 49.72,56.28 22.92,56.28 U8.7 ; 49.72,56.28 U8#2.7 ; 49.72,56.28 76.52,56.28 ; 104.68,59.35 101.6,56.28 97.67,56.28 ; 104.68,59.35 104.68,44.03 U7#4.8 100.52,39.88 ; 104.68,59.35 104.68,68.72 ; 104.68,68.72 NOREF#61.2 ; 104.68,68.72 SW2.6 ; 100.52,39.88 97.3,36.66 97.3,30.34 SW2#2.6 U6#2.10 88.17,28.83 NOREF#58.1 ; 100.52,39.88 78.74,39.88 ; U7#3.8 78.74,39.88 ; 78.74,39.88 51.93,39.88 ; 11.14,36.83 14.32,33.83 NOREF#68.2 ; 11.14,36.83 64.93,36.83 ; U7#4.9 99.06,46.36 77.66,46.36 U7#3.7 ; 51.93,39.88 U7#2.8 ; 51.93,39.88 25.13,39.88 U7.8 ; 64.93,36.83 67.93,33.83 ; U7#2.9 45.46,46.36 24.06,46.36 20.09,42.39 ; 70.51,33.78 67.68,30.95 19.74,30.95 U5.19 ; 76.52,56.28 97.67,56.28 ; 76.52,56.28 U8#3.7 ; 97.67,56.28 U8#4.7 ; U7#2.7 50.86,46.36 72.26,46.36 U7#3.9 ; 67.93,33.83 NOREF#66.2 ; 67.93,33.83 U6#2.20

## Text on the board
Top Silkscreen Layer: 100nF | _________________________________ | ______ | COUT | 15 14 13 12 3 2 1 0 | 11 10 9 8 7 6 5 4 | WRITE | 5V GND | INPUT1 | 15 | 14 | 13 | 12 | 11 | 10 | 9 | 8 | 7 | 6 | 5 | 4 | 3 | 2 | 1 | 0 | SUB | SN74CH283N | SN74CH86N | U | SN74CH245N | OUT
